# EasyEDA Pro project URADORRY-SUN1.2.eprj, board Sub - MAX3421E(1.2)
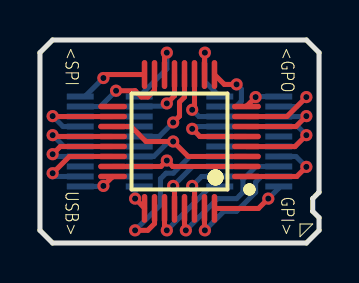
[diagram p7: board, top side]
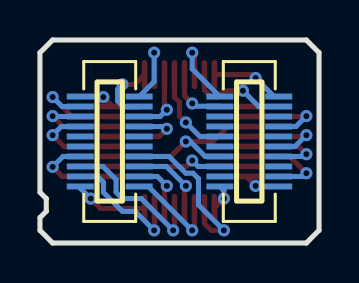
[diagram p8: board, bottom side, seen from below]

Outline 13.97 x 10.16 mm; copper layers: Top Layer, Bottom Layer. Coordinates in mm from the lower left corner of the outline.
Outline path: 0,9.52 0.64,10.16 13.34,10.16 13.97,9.52 13.97,2.54 13.65,2.22 13.65,1.59 13.97,1.27 13.97,0.64 13.34,0 0.64,0 0,0.64 0,9.52
Stack: Top Layer 0.035mm - / Dielectric1 0.71mm FR4 er 4.5 / Bottom Layer 0.035mm -

## Design rules (mm)
template: JLCPCB Capability(Two Layers Board)
spacing copperThickness1oz (default): track to track 0.102, other pairs 0.152 to 0.3
spacing copperThickness2oz: track to track 0.203, other pairs 0.152 to 0.3
track width copperThickness1oz (default): min 0.127, default 0.254, max 2.54
track width copperThickness2oz: min 0.203, default 0.254, max 2.54
differential pair differentialPair (default): width min 0.127, default 0.254, max 2.54; gap min 0.152, default 0.152
via viaSize (default): diameter min 0.5, default 0.61, max 10; hole min 0.3, default 0.305, max 6.3

## Placement (name value [footprint] x y rotation side)
MAX3421E  MAX3421EEHJ+T  [TQFP-32_L5.0-W5.0-P0.50-LS7.0-BL]  6.99 5.08 90 top
MTGPIO(M)/MX  AXK6F20547YG  [CONN-SMD_20P-P0.50_C2917022]  10.48 5.08 90 bottom
MTSYS(M)/MX  AXK6F20547YG  [CONN-SMD_20P-P0.50_C2917022]  3.49 5.08 90 bottom

## Footprints (pads in the part's own frame, mm; a bottom-side part is the same pattern mirrored in y, then rotated)
CONN-SMD_20P-P0.50_C2917022
  rect 0.3x1.35 smd: 1(-2.25,-1.475) 2(-2.25,1.475) 3(-1.75,-1.475) 4(-1.75,1.475) 5(-1.25,-1.475) 6(-1.25,1.475) 7(-0.75,-1.475) 8(-0.75,1.475) 9(-0.25,-1.475) 10(-0.25,1.475) 11(0.25,-1.475) 12(0.25,1.475) 13(0.75,-1.475) 14(0.75,1.475) 15(1.25,-1.475) 16(1.25,1.475) 17(1.75,-1.475) 18(1.75,1.475) 19(2.25,-1.475) 20(2.25,1.475)
TQFP-32_L5.0-W5.0-P0.50-LS7.0-BL
  oval 0.28x1.45 smd: 1(-1.75,-3.35) 2(-1.25,-3.35) 3(-0.75,-3.35) 4(-0.25,-3.35) 5(0.25,-3.35) 6(0.75,-3.35) 7(1.25,-3.35) 8(1.75,-3.35) 17(1.75,3.35) 18(1.25,3.35) 19(0.75,3.35) 20(0.25,3.35) 21(-0.25,3.35) 22(-0.75,3.35) 23(-1.25,3.35) 24(-1.75,3.35)
  oval 1.45x0.28 smd: 9(3.35,-1.75) 10(3.35,-1.25) 11(3.35,-0.75) 12(3.35,-0.25) 13(3.35,0.25) 14(3.35,0.75) 15(3.35,1.25) 16(3.35,1.75) 25(-3.35,1.75) 26(-3.35,1.25) 27(-3.35,0.75) 28(-3.35,0.25) 29(-3.35,-0.25) 30(-3.35,-0.75) 31(-3.35,-1.25) 32(-3.35,-1.75)

## Nets
As in the schematic.

Pads without a net: MAX3421E 17; MTGPIO(M)/MX 9 10 11 12; MTSYS(M)/MX 4 5 10 11 14 15 16

## Via types
v1: diameter 0.61, hole 0.305, Top Layer to Bottom Layer, 29 vias

## Routing (per net, layer and track width the routed paths; a pad name or vN(x,y) marks a point on that pad's centre or on a via; arc(x,y) is an arc through that point)
GND: length 9.3
  Top Layer w0.254: MAX3421E.19 4.56,5.83 5.31,5.08 v1(6.67,5.08) 7.42,4.33 MAX3421E.3
  Bottom Layer w0.254: v1(6.67,5.08) 6.45,5.08 5.7,4.33 MTSYS(M)/MX.8
+3.3V/MX: length 8.5
  Top Layer w0.254: MAX3421E.23 6.05,3.83 v1(6.35,4.13) 6.65,3.83 MAX3421E.2
  Bottom Layer w0.254: v1(6.35,4.13) 6.05,3.83 MTSYS(M)/MX.6
D+/MX: length 4.6
  Top Layer w0.254: v1(0.64,4.44) 1.02,4.83 MAX3421E.21
  Bottom Layer w0.254: MTSYS(M)/MX.7 0.75,4.33 v1(0.64,4.44)
D-/MX: length 4.6
  Top Layer w0.254: MAX3421E.20 0.7,5.33 v1(0.64,5.4)
  Bottom Layer w0.254: MTSYS(M)/MX.9 1.2,4.83 v1(0.64,5.4)
GPI0: length 8.4
  Top Layer w0.254: MAX3421E.26 5.74,0.97 5.4,0.64 v1(4.76,0.64)
  Bottom Layer w0.254: MTGPIO(M)/MX.7 7.51,4.33 6.67,3.49 6.31,3.49 6.03,3.22 6.03,1.91 v1(4.76,0.64)
GPI1: length 4.7
  Top Layer w0.254: MAX3421E.27 6.24,0.75 v1(6.35,0.64)
  Bottom Layer w0.254: MTGPIO(M)/MX.1 8.55,2.83 v1(6.35,0.64)
GPI2: length 3.9
  Top Layer w0.254: MAX3421E.28 6.74,2.79 v1(6.67,2.86)
  Bottom Layer w0.254: MTGPIO(M)/MX.5 7.64,3.83 v1(6.67,2.86)
GPI3: length 7.5
  Top Layer w0.254: v1(7.3,0.64) 7.24,0.7 MAX3421E.29
  Bottom Layer w0.254: v1(7.3,0.64) 8.89,2.22 9.84,2.22 10.16,2.54 10.16,3.17 10.82,3.83 MTGPIO(M)/MX.6
GPI4: length 2.8
  Top Layer w0.254: v1(7.62,2.86) 7.74,2.74 7.74,1.74 MAX3421E.30
  Bottom Layer w0.254: v1(7.62,2.86) 8.09,3.33 MTGPIO(M)/MX.3
GPI5: length 6.2
  Top Layer w0.254: MAX3421E.31 8.24,0.66 v1(8.26,0.64)
  Bottom Layer w0.254: MTGPIO(M)/MX.4 11.08,3.33 10.8,3.05 10.8,2.54 9.84,1.59 9.21,1.59 v1(8.26,0.64)
GPI6: length 3.7
  Top Layer w0.254: v1(11.43,2.22) 10.94,1.73 MAX3421E.32
  Bottom Layer w0.254: MTGPIO(M)/MX.2 11.95,2.75 v1(11.43,2.22)
GPI7: length 4.8
  Top Layer w0.254: MAX3421E.1 12.86,3.33 v1(13.34,3.81)
  Bottom Layer w0.254: MTGPIO(M)/MX.8 12.82,4.33 v1(13.34,3.81)
GPO0: length 4.8
  Top Layer w0.254: v1(13.34,5.4) 12.76,4.83 10.34,4.83 MAX3421E.4
  Bottom Layer w0.254: MTGPIO(M)/MX.14 12.9,5.83 v1(13.34,5.4)
GPO1: length 4.3
  Top Layer w0.254: v1(7.62,5.72) 8.01,5.33 MAX3421E.5
  Bottom Layer w0.254: v1(7.62,5.72) 7.74,5.83 MTGPIO(M)/MX.13
GPO2: length 4.6
  Top Layer w0.254: v1(13.34,6.35) 12.82,5.83 MAX3421E.6
  Bottom Layer w0.254: MTGPIO(M)/MX.16 13.32,6.33 v1(13.34,6.35)
GPO3: length 5
  Top Layer w0.254: MAX3421E.7 12.36,6.33 v1(13.34,7.3)
  Bottom Layer w0.254: MTGPIO(M)/MX.18 12.86,6.83 v1(13.34,7.3) 13.31,7.33
GPO4: length 1.8
  Top Layer w0.254: v1(10.8,7.3) 10.34,6.84 MAX3421E.8
  Bottom Layer w0.254: v1(10.8,7.3) 10.82,7.33 MTGPIO(M)/MX.20
GPO5: length 3.4
  Top Layer w0.254: MAX3421E.9 9.23,7.94 v1(9.84,7.94)
  Bottom Layer w0.254: MTGPIO(M)/MX.17 9.01,6.82 9.81,6.82 10.08,7.1 10.08,7.7 v1(9.84,7.94)
GPO6: length 3.6
  Top Layer w0.254: v1(8.26,9.52) 8.24,9.52 MAX3421E.10
  Bottom Layer w0.254: MTGPIO(M)/MX.19 8.26,8.08 v1(8.26,9.52)
GPO7: length 3.3
  Top Layer w0.254: v1(7.62,6.67) 7.74,6.78 MAX3421E.11
  Bottom Layer w0.254: MTGPIO(M)/MX.15 7.96,6.33 v1(7.62,6.67)
INT/MX: length 4.6
  Top Layer w0.254: v1(0.64,6.35) 0.66,6.33 MAX3421E.18
  Bottom Layer w0.254: v1(0.64,6.35) 1.16,5.83 MTSYS(M)/MX.13
MISO/MX: length 5.1
  Top Layer w0.254: v1(3.81,7.62) 4.77,7.62 5.08,7.31 5.4,7.31 5.74,7.64 MAX3421E.15
  Bottom Layer w0.254: MTSYS(M)/MX.17 3.02,6.83 v1(3.81,7.62)
MOSI/MX: length 3.7
  Top Layer w0.254: MAX3421E.16 3.35,8.43 v1(3.18,8.25)
  Bottom Layer w0.254: v1(3.18,8.25) 2.25,7.33 MTSYS(M)/MX.19
RST/MX: length 4.6
  Top Layer w0.254: v1(6.67,6.03) 6.99,6.35 6.99,7.05 7.24,7.3 MAX3421E.12
  Bottom Layer w0.254: MTSYS(M)/MX.12 5.97,5.33 v1(6.67,6.03)
SCLK/MX: length 3.1
  Top Layer w0.254: v1(6.35,6.98) 6.74,7.37 MAX3421E.13
  Bottom Layer w0.254: v1(6.35,6.98) 6.21,6.85 4.99,6.85 MTSYS(M)/MX.18
SS/MX: length 3.9
  Top Layer w0.254: v1(6.35,9.52) 6.24,9.41 MAX3421E.14
  Bottom Layer w0.254: v1(6.35,9.52) 6.35,8.71 MTSYS(M)/MX.20
VBCP/MX: length 4.8
  Top Layer w0.254: v1(0.64,3.49) 1.47,4.33 MAX3421E.22
  Bottom Layer w0.254: MTSYS(M)/MX.3 0.8,3.33 v1(0.64,3.49)
XI/MX: length 1.8
  Top Layer w0.254: v1(3.18,2.86) 3.64,3.32 MAX3421E.24
  Bottom Layer w0.254: v1(3.18,2.86) 3.15,2.83 MTSYS(M)/MX.1
XO/MX: length 1.4
  Top Layer w0.254: v1(4.76,2.22) 5.24,1.75 MAX3421E.25
  Bottom Layer w0.254: MTSYS(M)/MX.2 4.76,2.62 v1(4.76,2.22)

## Text on the board
Top Silkscreen Layer: <SPI | <GPO | USB> | GPI>
